# EAGLE board MCS (EAGLE 6.5.0)
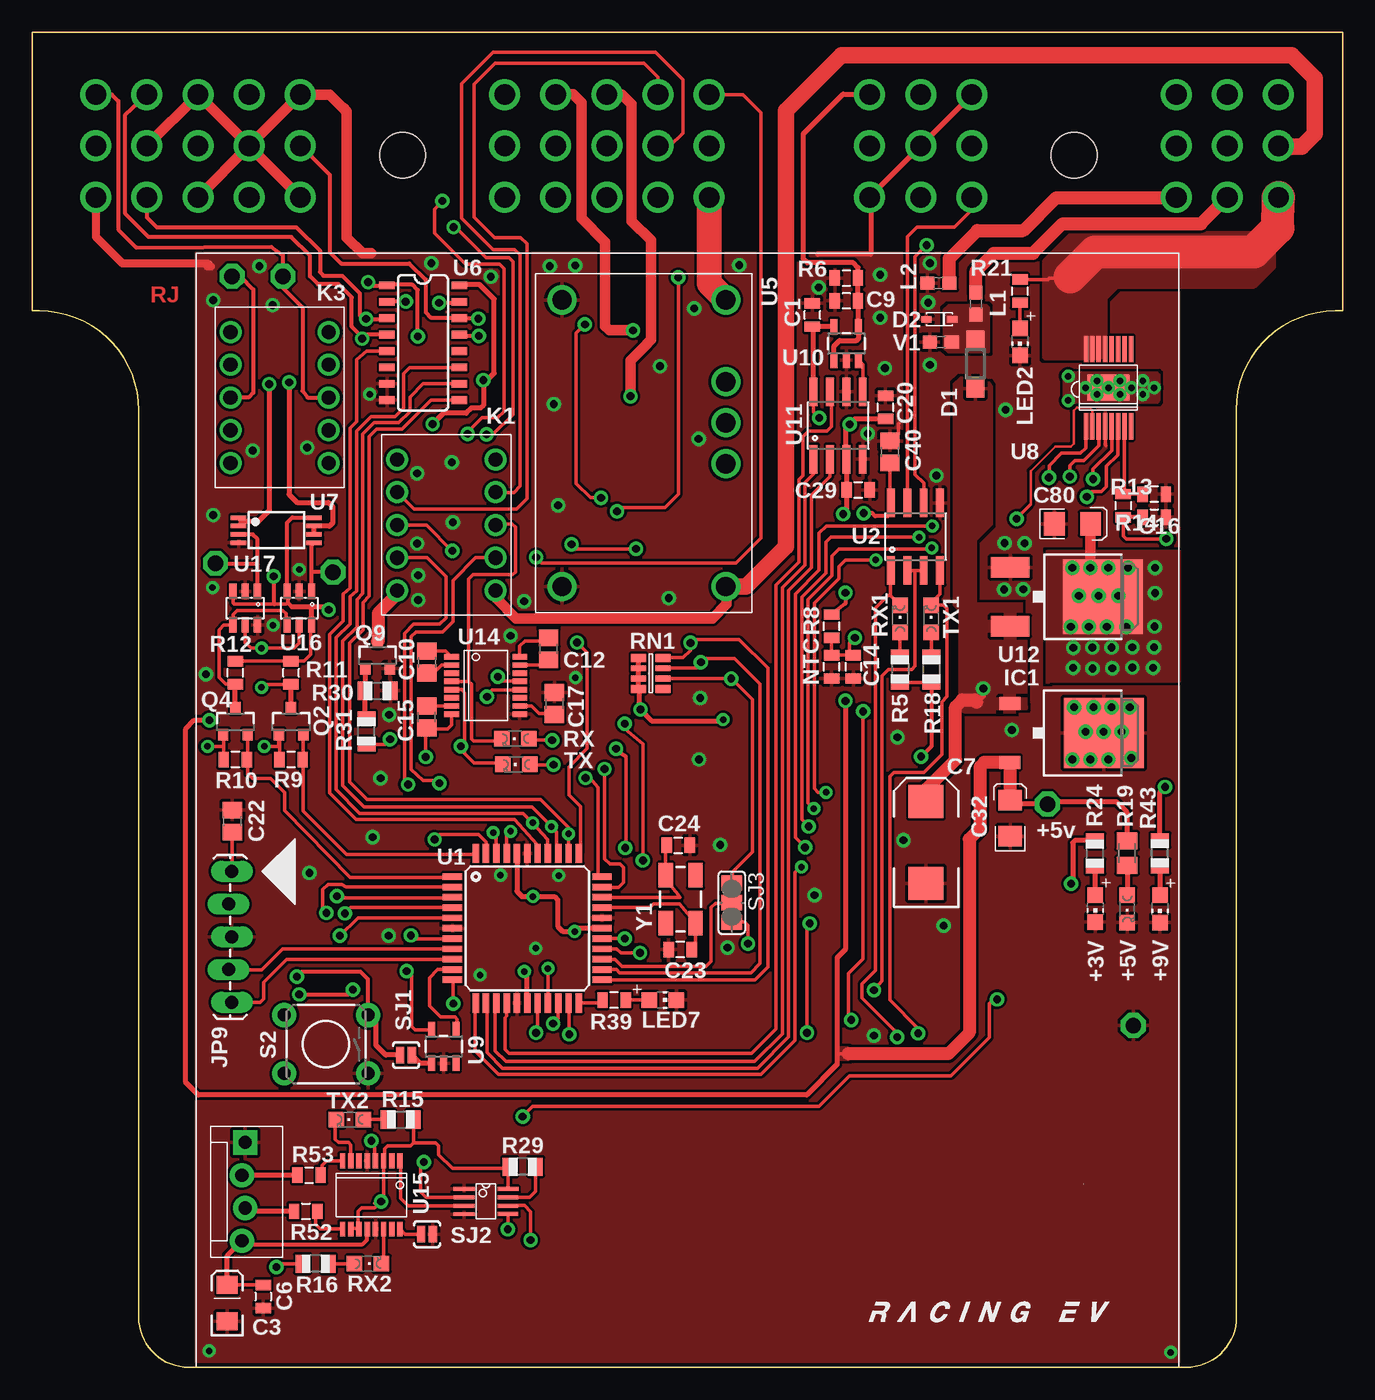
[diagram p3: board, top side]
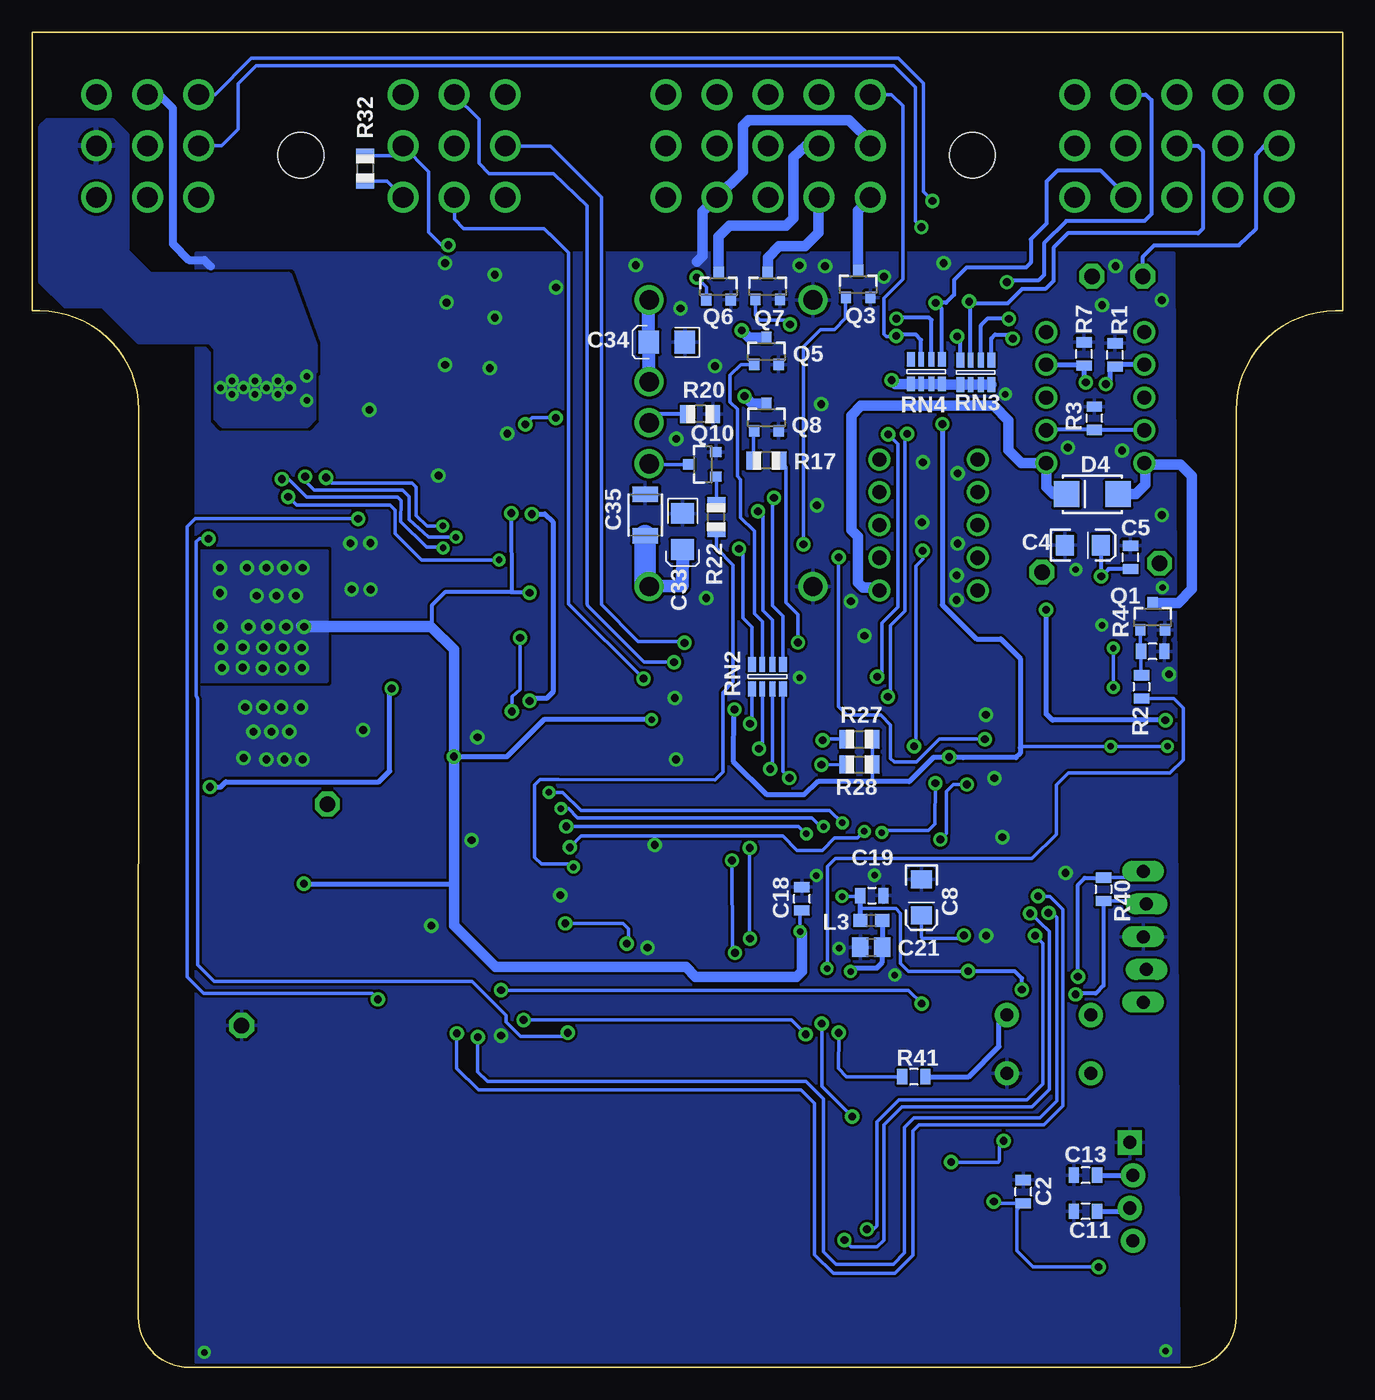
[diagram p4: board, bottom side, seen from below]

Size 101.6 x 103.51 mm. Coordinates in mm from the lower left corner, seen from the top.
Copper layers (1*16): Top 0.035mm / dielectric 1.5mm / Bottom 0.035mm
Design rules "SparkFun": minimum track width 8mil, minimum drill 20mil, track to track 8mil, track to pad 8mil, pad to pad 8mil, via to via 8mil, smd to smd 8mil, copper to edge 10mil, drill to drill 8mil, minimum pad ring 12mil, minimum via ring 10mil, stop-mask expansion 4mil, vias tented up to drill 25mil, thermal gap 10mil

## Footprints (pad centres in the part's own frame; a part is rotated, then mirrored left to right if it is on the bottom)
CHIP-LED0805 = smd 1.2 x 1.2: A 0,-1.05; C 0,1.05
CHIPLED_0805 = smd 1.2 x 1.2: A 0,-1.05; C 0,1.05
0805 = smd 0.8 x 1.2: 1 -0.9,0; 2 0.9,0
EIA3216 = smd 1.4 x 1.6: A 1.4,0; C -1.4,0
EIA7343 = smd 2.55 x 2.7: A 3.17,0; C -3.17,0
C0805 = smd 1.3 x 1.5: 1 -0.85,0; 2 0.85,0
POLC1206 = smd 1.6 x 1.8: 1 -1.4,0; 2 1.4,0
1210 = smd 1.2 x 2: 1 -1.6,0; 2 1.6,0
581-01-48-009 = drill 1.6: 1 -45.872,4.699; 2 -45.872,0.711; 3 -45.872,-3.277; 4 -41.91,4.699; 5 -41.91,0.711; 6 -41.91,-3.277; 7 -37.948,4.699; 8 -37.948,0.711; 9 -37.948,-3.277; 10 -33.985,4.699; 11 -33.985,0.711; 12 -33.985,-3.277; 13 -30.023,4.699; 14 -30.023,0.711; 15 -30.023,-3.277; 16 -14.173,4.699; 17 -14.173,0.711; 18 -14.173,-3.277; 19 -10.211,4.699; 20 -10.211,0.711; 21 -10.211,-3.277; 22 -6.248,4.699; 23 -6.248,0.711; 24 -6.248,-3.277; 25 -2.286,4.699; 26 -2.286,0.711; 27 -2.286,-3.277; 28 1.676,4.699; 29 1.676,0.711; 30 1.676,-3.277; 31 14.122,4.699; 32 14.122,0.711; 33 14.122,-3.277; 34 18.085,4.699; 35 18.085,0.711; 36 18.085,-3.277; 37 22.047,4.699; 38 22.047,0.711; 39 22.047,-3.277; 40 37.897,4.699; 41 37.897,0.711; 42 37.897,-3.277; 43 41.859,4.699; 44 41.859,0.711; 45 41.859,-3.277; 46 45.822,4.699; 47 45.822,0.711; 48 45.822,-3.277 | hole 3.556: -22.098,0; 29.972,0
SOD123 = smd 1.4 x 1.4: A 1.9,0; C -1.9,0
SOD-523F = smd 0.8 x 0.5: A -1,0; C 1,0
SMA-DIODE_ALT = smd 2 x 2: A -2,0; C 2,0
TO252 = smd 1 x 1.6: 1 -2.28,-4.8; 2 2.28,-4.8 | smd 5.4 x 6.2: 3 0,2.5
1X05_LOCK_LONGPADS = drill 1.016 long: 1 0,0; 2 2.54,-0.254; 3 5.08,0; 4 7.62,-0.254; 5 10.16,0
MOLEX-1X4_LOCK = drill 1.016 pad 1.88 square: 1 0,0.127 | drill 1.016 pad 1.88: 2 2.54,-0.127; 3 5.08,0.127; 4 7.62,-0.127
TQ2-2M-24V = drill 1.1: 1 -5.08,-3.81; 2 -2.54,-3.81; 3 0,-3.81; 4 2.54,-3.81; 5 5.08,-3.81; 6 5.08,3.81; 7 2.54,3.81; 8 0,3.81; 9 -2.54,3.81; 10 -5.08,3.81
0603 = smd 1.1 x 1: 1 -0.85,0; 2 0.85,0
SOT23-3 = smd 0.8 x 0.9: 1 -0.95,-1; 2 0.95,-1; 3 0,1.1
R0805 = smd 1.1 x 1.4: 1 -1,0; 2 1,0
M0805 = smd 1.3 x 1.6: 1 -0.95,0; 2 0.95,0
CRA06S = smd 0.63 x 1.15: 1 -1.2,-1; 4 1.2,-1; 5 1.2,0.9; 8 -1.2,0.9 | smd 0.44 x 1.15: 2 -0.4,-1; 3 0.4,-1; 6 0.4,0.9; 7 -0.4,0.9
TACTILE-PTH = drill 1.016 pad 1.88: 1 -3.251,2.261; 2 3.251,2.261; 3 -3.251,-2.261; 4 3.251,-2.261
SJ_2S-NO = smd 0.635 x 1.27: 1 -0.45,0; 2 0.45,0
PAD-JUMPER-2-NO_YES_SILK = smd 0.635 x 1.27: 1 -0.45,0; 2 0.45,0
PAD-JUMPER-3-NO_YES_SILK_FULL_BOX = smd 1.168 x 1.6: 1 -1.524,0; 2 0,0; 3 1.524,0
4952 = drill 1.2 pad 1.93 octagon: P$1 0,0
TQFP-44 = smd 1.5 x 0.5: 1 -5.8,4; 2 -5.8,3.2; 3 -5.8,2.4; 4 -5.8,1.6; 5 -5.8,0.8; 6 -5.8,0; 7 -5.8,-0.8; 8 -5.8,-1.6; 9 -5.8,-2.4; 10 -5.8,-3.2; 11 -5.8,-4; 23 5.8,-4; 24 5.8,-3.2; 25 5.8,-2.4; 26 5.8,-1.6; 27 5.8,-0.8; 28 5.8,0; 29 5.8,0.8; 30 5.8,1.6; 31 5.8,2.4; 32 5.8,3.2; 33 5.8,4 | smd 0.5 x 1.5: 12 -4,-5.8; 13 -3.2,-5.8; 14 -2.4,-5.8; 15 -1.6,-5.8; 16 -0.8,-5.8; 17 0,-5.8; 18 0.8,-5.8; 19 1.6,-5.8; 20 2.4,-5.8; 21 3.2,-5.8; 22 4,-5.8; 34 4,5.8; 35 3.2,5.8; 36 2.4,5.8; 37 1.6,5.8; 38 0.8,5.8; 39 0,5.8; 40 -0.8,5.8; 41 -1.6,5.8; 42 -2.4,5.8; 43 -3.2,5.8; 44 -4,5.8
SO-8 = smd 0.61 x 2.21: 1 -1.905,-2.616; 2 -0.635,-2.616; 3 0.635,-2.616; 4 1.905,-2.616; 5 1.905,2.616; 6 0.635,2.616; 7 -0.635,2.616; 8 -1.905,2.616
VFSOP-8 = smd 0.3 x 1.6: 1 -0.98,-1.7; 2 -0.33,-1.7; 3 0.33,-1.7; 4 0.98,-1.7; 5 0.97,1.69; 6 0.325,1.7; 7 -0.33,1.7; 8 -0.98,1.71
PTN78060HAH = drill 1.5: 1 2.032,14.732; 2 2.032,2.032; 3 11.557,2.032; 4 14.732,2.032; 5 17.907,2.032; 6 24.257,2.032; 7 24.257,14.732
SO016 = smd 0.6 x 1.2: 1 -4.445,-2.8; 2 -3.175,-2.8; 3 -1.905,-2.8; 4 -0.635,-2.8; 5 0.635,-2.8; 6 1.905,-2.8; 7 3.175,-2.8; 8 4.445,-2.8; 9 4.445,2.8; 10 3.175,2.8; 11 1.905,2.8; 12 0.635,2.8; 13 -0.635,2.8; 14 -1.905,2.8; 15 -3.175,2.8; 16 -4.445,2.8
TSSOP-08 = smd 1.2 x 0.35: 1 -2.925,0.975; 2 -2.925,0.325; 3 -2.925,-0.325; 4 -2.925,-0.975; 5 2.925,-0.975; 6 2.925,-0.325; 7 2.925,0.325; 8 2.925,0.975
SSO-16-POWER = smd 2.032 x 0.35: 1 -3,1.75; 2 -3,1.25; 3 -3,0.75; 4 -3,0.25; 5 -3,-0.25; 6 -3,-0.75; 7 -3,-1.25; 8 -3,-1.75; 9 3,-1.75; 10 3,-1.25; 11 3,-0.75; 12 3,-0.25; 13 3,0.25; 14 3,0.75; 15 3,1.25; 16 3,1.75 | smd 2 x 3.25: EP 0,0
SOT23-5L = smd 0.55 x 1.2: 1 -0.95,-1.3; 2 0,-1.3; 3 0.95,-1.3; 4 0.95,1.3; 5 -0.95,1.3
SOT23-5 = smd 0.55 x 1.2: 1 -0.95,-1.3; 2 0,-1.3; 3 0.95,-1.3; 4 0.95,1.3; 5 -0.95,1.3
SO08 = smd 0.61 x 2.21: 1 -1.905,-2.616; 2 -0.635,-2.616; 3 0.635,-2.616; 4 1.905,-2.616; 5 1.905,2.616; 6 0.635,2.616; 7 -0.635,2.616; 8 -1.905,2.616
V-REG_DPACK = smd 1.6 x 3: 1 -2.28,-4.8; 3 2.28,-4.8 | smd 5.8 x 6.2: 4 0,2.38
SSOP-16 = smd 0.419 x 1.143: 1 -2.223,-2.642; 2 -1.587,-2.642; 3 -0.953,-2.642; 4 -0.318,-2.642; 5 0.318,-2.642; 6 0.953,-2.642; 7 1.587,-2.642; 8 2.223,-2.642; 9 2.223,2.642; 10 1.587,2.642; 11 0.953,2.642; 12 0.318,2.642; 13 -0.318,2.642; 14 -0.953,2.642; 15 -1.587,2.642; 16 -2.223,2.642
SOT23-6 = smd 0.55 x 1.2: 1 -0.95,-1.3; 2 0,-1.3; 3 0.95,-1.3; 4 0.95,1.3; 5 0,1.3; 6 -0.95,1.3
CRYSTAL-SMD-5X3 = smd 1.9 x 1.1: 1 -1.85,-1.15; 2 1.85,-1.15; 3 1.85,1.15; 4 -1.85,1.15

## Placement (x,y rotation side)
+3V  [CHIP-LED0805]  82.42,35.56 180 top
+5V  Green  [CHIPLED_0805]  84.89,35.53 180 top
+9V  [CHIP-LED0805]  87.43,35.53 180 top
C1  0.1uF  [0805]  60.48,81.58 90 top
C2  0.1uf  [0805]  24.76,13.61 90 bottom
C3  4.7uF  [EIA3216]  15.11,4.98 90 top
C4  10uF  [EIA3216]  20.14,63.73 0 bottom
C5  0.1uF  [0805]  16.46,62.79 90 bottom
C6  0.1uf  [0805]  17.91,5.49 270 top
C7  100uF  [EIA7343]  69.29,40.69 90 top
C8  10uF  [EIA3216]  32.66,36.42 270 bottom
C9  10pF  [0805]  63.12,82.68 180 top
C10  .1uF  [C0805]  30.61,54.69 270 top
C11  47pf  [0805]  19.94,12.09 180 bottom
C12  .1uF  [C0805]  40.03,55.7 270 top
C13  47pf  [0805]  19.94,14.88 180 bottom
C14  0.1uF  [0805]  63.65,54.31 270 top
C15  .1uF  [C0805]  30.58,50.42 270 top
C16  10pF  [0805]  86.99,65.91 0 top
C17  .1uF  [C0805]  40.49,51.46 270 top
C18  0.1uF  [0805]  41.94,36.32 90 bottom
C19  0.1uF  [0805]  36.5,36.58 0 bottom
C20  0.1uF  [0805]  66.17,74.42 90 top
C21  100n  [C0805]  36.55,32.56 180 bottom
C22  10n  [C0805]  15.52,42.34 90 top
C23  12pF  [0805]  50.24,32.39 180 top
C24  12pF  [0805]  50.09,40.46 0 top
C29  0.1uF  [0805]  64.03,68.02 0 top
C32  10uF  [POLC1206]  75.82,42.57 270 top
C33  10uF  [POLC1206]  51.18,64.8 90 bottom
C34  10uF  [POLC1206]  52.4,79.48 0 bottom
C35  1uf  [1210]  54.08,66.07 90 bottom
C40  .1uF  [C0805]  66.5,70.97 90 top
C80  10uF  [POLC1206]  80.65,65.39 180 top
CASE2  581-01-48-009  [581-01-48-009]  50.8,93.98 0 top
D1  1N4001  [SOD123]  73.13,77.78 90 top
D2  MM5Z30  [SOD-523F]  70.33,81.25 0 top
D4  [SMA-DIODE_ALT]  19.41,67.69 180 bottom
IC1  7805DT  [TO252]  80.59,49.17 270 top
JP9  ICSP  [1X05_LOCK_LONGPADS]  15.47,38.46 270 top
JP13  [MOLEX-1X4_LOCK]  16.38,17.42 270 top
K1  TQ2-2M-24V  [TQ2-2M-24V]  32.11,65.3 90 top
K3  TQ2-2M-24V  [TQ2-2M-24V]  19.18,75.18 90 top
L1  FB  [0603]  73.17,82.47 270 top
L2  FB  [0603]  70.26,84.04 180 top
L3  FB  [0603]  36.55,34.65 180 bottom
LED2  [CHIP-LED0805]  76.58,79.5 180 top
LED7  [CHIP-LED0805]  48.89,28.47 270 top
NTC  [0805]  61.98,54.31 90 top
Q1  BSS123  [SOT23-3]  14.73,58.17 0 bottom
Q2  BSS123  [SOT23-3]  20.07,50.04 0 top
Q3  BSS123  [SOT23-3]  37.57,83.95 0 bottom
Q4  BSS123  [SOT23-3]  15.75,50.04 0 top
Q5  BSS123  [SOT23-3]  44.68,78.74 0 bottom
Q6  BSS123  [SOT23-3]  48.39,83.77 0 bottom
Q7  BSS123  [SOT23-3]  44.58,83.79 0 bottom
Q8  BSS123  [SOT23-3]  44.68,73.61 0 bottom
Q9  BSS123  [SOT23-3]  26.77,55.17 0 top
Q10  BSS123  [SOT23-3]  49.61,70 90 bottom
R1  10k  [0805]  17.65,78.49 90 bottom
R2  1k  [0805]  15.6,52.76 270 bottom
R3  100  [0805]  19.25,73.58 90 bottom
R4  100k  [0805]  14.73,55.5 180 bottom
R5  1K  [R0805]  67.28,54.1 270 top
R6  10k  [0805]  63.12,84.45 0 top
R7  10k  [0805]  20.07,78.56 90 bottom
R8  10k  [0805]  61.98,57.45 90 top
R9  2k  [0805]  20.07,47.12 180 top
R10  2k  [0805]  15.75,47.12 180 top
R11  10k  [0805]  20.07,53.85 90 top
R12  10k  [0805]  15.75,53.85 90 top
R13  10k  [0805]  86.99,67.69 180 top
R14  10k  [0805]  84.58,66.8 270 top
R15  1K  [R0805]  28.57,19.2 0 top
R16  1k  [R0805]  21.97,8.03 180 top
R17  1K  [R0805]  44.68,70.31 180 bottom
R18  1k  [R0805]  69.7,54.1 270 top
R19  1K  [M0805]  84.89,39.85 270 top
R20  383k  [R0805]  49.81,73.91 180 bottom
R21  3.3k  [0805]  76.58,83.44 90 top
R22  1K  [R0805]  48.56,65.91 90 bottom
R24  499  [R0805]  82.4,39.83 90 top
R27  1K  [R0805]  37.46,48.69 0 bottom
R28  1k  [R0805]  37.46,46.74 0 bottom
R29  1K  [R0805]  38.02,15.54 180 top
R30  10K  [R0805]  26.77,52.45 0 top
R31  1K  [R0805]  25.91,49.3 90 top
R32  120  [R0805]  75.79,92.94 270 bottom
R39  499  [0805]  45.11,28.47 180 top
R40  10k  [0805]  18.54,37.06 270 bottom
R41  499  [0805]  33.25,22.53 180 bottom
R43  1.2k  [R0805]  87.43,39.85 90 top
R52  27  [0805]  21.21,12.09 0 top
R53  27  [0805]  21.46,14.88 0 top
RN1  RN-4  [CRA06S]  48.01,53.8 270 top
RN2  RN-4  [CRA06S]  44.6,53.59 0 bottom
RN3  RN-4  [CRA06S]  28.45,77.09 180 bottom
RN4  RN-4  [CRA06S]  32.28,77.14 180 bottom
RX  [CHIPLED_0805]  37.46,48.74 90 top
RX1  RED  [CHIPLED_0805]  67.28,58.04 0 top
RX2  [CHIPLED_0805]  26.03,8.03 270 top
S2  ts  [TACTILE-PTH]  22.78,25.04 180 top
SJ1  SJ-NO  [SJ_2S-NO]  28.98,24.21 180 top
SJ2  [PAD-JUMPER-2-NO_YES_SILK]  30.61,10.31 180 top
SJ3  [PAD-JUMPER-3-NO_YES_SILK_FULL_BOX]  54.23,36.02 270 top
TP1  TESTPOINT  [4952]  85.37,26.49 0 top
TP2  TESTPOINT  [4952]  78.71,43.66 0 top
TP3  TESTPOINT  [4952]  23.32,61.65 180 top
TP4  TESTPOINT  [4952]  15.49,84.58 0 top
TP5  TESTPOINT  [4952]  19.43,84.58 0 top
TP8  TESTPOINT  [4952]  14.2,62.33 180 top
TX  [CHIPLED_0805]  37.54,46.74 90 top
TX1  GREEN  [CHIPLED_0805]  69.7,58.04 0 top
TX2  [CHIPLED_0805]  24.64,19.2 90 top
U1  DSPIC33FJ128GP804  [TQFP-44]  38.38,34.04 0 top
U2  SN75HVD08DR  [SO-8]  68.48,64.39 0 top
U4  SN74LVC2G241DCTR  [VFSOP-8]  35.18,12.85 270 top
U5  PTN78060HAH  [PTN78060HAH]  55.8,58.5 90 top
U6  SN74HC251_SMD  [SO016]  30.3,79.43 270 top
U7  LM158  [TSSOP-08]  18.92,64.9 0 top
U8  VND7040AJTR-E  [SSO-16-POWER]  83.44,75.95 90 top
U9  MAX823  [SOT23-5L]  31.9,24.87 0 top
U10  OPA344  [SOT23-5]  63.12,79.38 0 top
U11  X9015_DIGI_POTS  [SO08]  62.48,73.03 0 top
U12  NCP1117DT33T5G  [V-REG_DPACK]  80.62,59.74 270 top
U14  ADM3101E  [SSOP-16]  35.15,52.86 270 top
U15  FT230X  [SSOP-16]  26.29,13.36 180 top
U16  MCP4725  [SOT23-6]  20.7,58.85 180 top
U17  MCP4725  [SOT23-6]  16.51,58.85 180 top
U$1  LOGOM  [L-M]  57.35,1.5 0 top
U$2  INDPK1  [PICKIT-PIN-1]  17.83,38.43 270 top
V1  13Vdc  [0603]  70.44,79.47 0 top
Y1  12Mhz  [CRYSTAL-SMD-5X3]  50.27,36.3 90 top

## Tracks (layer width: path | path; a pad name or v marks a point on that pad's centre or on a via)
3V  (via drill 0.6)
  Top 0.254: 25.27,10.78 25.27,12.09 25.53,12.34 26.54,12.34 v27.05,12.85 26.91,12.71 26.54,12.71 27.24,13.41 U15.3 27.31,16.07 27.31,16.92 27.56,17.17 29.34,17.17 29.58,17.41 | 25.27,10.78 U15.11 | 25.27,10.78 24.77,10.78 U15.10 | R16.2 19.18,8.03 v18.92,7.77 | R15.2 29.58,17.41 | U4.8 36.89,15.41 | 36.89,15.41 R29.2 | 36.89,15.41 32.57,15.41 31.5,16.48 31.5,17.17 31.27,17.4 29.58,17.4 29.58,17.41
  Bottom 0.254: v27.05,12.85 26.91,12.71 C2.1 25.27,12.21 25.27,9.04 24,7.77 v18.92,7.77
12V-EN  (via drill 0.5)
  Top 0.254: U1.12 34.34,28.2 34.34,24.51 36.14,22.71 56.49,22.71 59.13,25.35 59.13,38.38 59.54,38.79 v59.64,38.79
  Bottom 0.254: R22.1 48.56,63.5 47.27,62.2 47.27,53.11 48.06,52.32 48.06,46.15 48.67,45.54 60.81,45.57 62.23,45.57 62.64,45.16 62.64,39.52 62.13,39.01 59.87,39.01 v59.64,38.79
!CS
  Top 0.254: U1.15 36.78,27.23 36.65,27.1 36.65,24.64 36.96,24.33 55.75,24.33 57.66,26.24 57.66,60.65 59.44,62.43 59.44,68.81 59.77,69.14 59.77,72.16 60.2,72.59 61.62,72.59 61.95,72.92 61.95,75.54 U11.7
!RST  (via drill 0.6)
  Top 0.203: U8.2 82.19,74.19 81.99,74.4 80.98,74.4 80.75,74.17 80.75,71.63 80.52,71.4 79.32,71.4 77.42,69.49 77.42,66.9 77.34,66.83
  Top 0.254: U1.20 40.78,27.04 v40.39,26.64 | v38.02,19.43 38.02,19.46 38.79,20.22 60.99,20.22 63.37,22.61 71.22,22.61 74.19,25.58 74.19,28.19 74.52,28.52 v74.8,28.52 | v76.33,65.79 76.3,65.79 77.34,66.83 | U8.2
  Bottom 0.254: v40.39,26.64 40.39,21.79 v38.02,19.43 | v76.33,65.79 88.98,65.79 89.59,65.18 89.59,30.25 88.32,28.98 75.26,28.98 v74.8,28.52
+
  Top 1.016: L1.1 73.17,84.99 74.55,86.36 77.6,86.36 79.88,88.65 90.6,88.65 CASE2.45
+3V3  (via drill 0.5, 0.6)
  Top 0.254: U14.8 32.51,49.81 32.21,49.5 30.65,49.5 C15.2 30.51,49.49 v30.51,47.32 | R18.2 R5.2 | Q4.1 14.85,48.99 R10.2 14.85,48.02 14.73,48.13 v13.59,48.13 | R9.2 19.17,48.99 Q2.1 19.12,48.2 19.05,48.13 v17.98,48.13 | C40.1 66.5,67.08 U2.8 | U9.5 29.69,26.17 29.41,26.44 29.41,30.33 v29.03,30.71
  Top 0.305: U2.8 66.57,66.24 66.32,65.99 65.35,65.99 65.13,66.22 v64.47,66.22 | v63.04,60.05 63.04,59.19 R8.2 | R18.2 69.7,48.13 v68.91,47.35 | v20.7,28.9 24.49,28.9 v24.87,29.29
  Top 0.406: v34.98,76.53 35,76.53 | U6.16 33.18,83.95 34.67,83.95 35.81,82.83 35.81,77.06 35.28,76.53 35,76.53 | 35,76.53 34.98,76.5 34.98,74.57 34.77,74.37 34.06,74.37 33.66,73.96 31.88,73.96 v31.04,73.13 | RN1.1 RN1.2 RN1.3 RN1.4 47.09,52.51 47.09,51.05 v47.16,50.99 48.03,50.11 53.47,50.11 v53.57,50.22 | U1.28 42.32,34.04 v42.06,33.78 42.04,33.81 41.12,33.81 40.74,34.19 40.74,36.25 40.49,36.5 v38.81,36.5 37.97,36.5 37.58,36.89 U1.40 | R24.2 80.83,40.83 80.67,40.67 80.67,37.62 v80.54,37.49
  Top 0.813: C80.1 82.05,63.33 | 82.05,63.33 82.04,63.32 | 82.05,63.33 v82.05,61.98 v82.04,61.98
  Bottom 0.254: v42.06,33.78 42.06,35.29 C18.1 | R27.2 R28.2 36.47,45.56 36.32,45.41 | v13.59,48.13 v17.98,48.13 24.89,48.13 24.99,48.03 | 37.4,34.42 L3.2 | 29.46,47.29 30.4,47.29 v30.51,47.32 | R40.2 15.46,36.16 JP9.2 | v29.03,30.71 33.68,30.71 34.29,31.32 34.29,35.18 34.65,35.56 37.4,35.56 | v38.81,36.5 37.48,36.5 C19.1
  Bottom 0.305: v64.47,66.22 64.44,60.1 | 64.44,60.1 63.09,60.1 v63.04,60.05 | 64.44,60.1 69.6,60.1 70.64,59.05 70.64,57.43 70.66,57.4 | R40.2 18.54,29.59 19.15,28.98 20.4,28.98 v20.7,28.9 | v24.87,29.29 24.87,30.15 25.43,30.71 v29.03,30.71
  Bottom 0.406: v31.04,73.13 31.04,59.11 28.4,56.46 26.52,56.46 24.99,54.94 24.99,48.03 24.99,47.6 25.32,47.27 29.44,47.27 29.46,47.29 31.72,47.29 33.6,45.41 36.32,45.41 40.67,45.41 41.78,44.37 44.63,44.37 47.22,46.94 47.19,50.95 v47.16,50.99 | 37.4,34.42 37.4,35.56 C19.1 | v53.57,50.22 61.93,50.22 64.82,47.32 68.88,47.32 v68.91,47.35 | v80.54,37.49 69.19,37.49 68.91,37.77
  Bottom 0.813: RN3.8 RN3.7 RN3.6 RN3.5 31.03,76.19 RN4.8 RN4.7 RN4.6 34.69,76.24 v34.98,76.53 | v80.52,57.4 70.66,57.4 68.91,55.65 v68.91,47.35 68.91,37.77 68.91,34.26 65.68,31.04 50.93,31.04 50.17,30.28 42.37,30.28 41.94,30.71 41.94,33.65 v42.06,33.78 | 80.75,57.45 70.89,57.45
  other vias: 80.64,61.98 83.44,61.98 84.96,61.98 81.91,57.4 83.31,57.4 84.84,57.4 81.15,59.82 82.68,59.82 84.2,59.82 85.29,55.83 80.72,55.78 80.7,54.23 82.19,55.8 82.22,54.18 83.69,55.8 83.74,54.2 85.29,54.25 87.05,61.98 87.05,60.02 87.02,57.43 86.97,55.83 86.89,54.23
  pour Top (no thermals): 78.74,63.25 88.9,63.25 88.9,53.21 78.87,53.21 78.74,53.09
  pour Bottom: 78.74,63.25 88.9,63.25 88.9,53.21 78.74,53.21
+5V  (via drill 0.6)
  Top 0.254: R12.2 R11.2 21.09,54.75 21.59,55.24 21.59,57.49 | 19.81,60.09 U16.3 | U17.3 15.56,59.27 15.67,59.16 18.77,59.16 19.69,59.16 19.81,59.28 | U11.8 60.58,74.04 v61.01,73.61 | 63.09,70.43 U11.3 | 63.25,24.31 62.48,24.31 62.41,24.23
  Top 0.305: U16.3 19.75,65.47 20.17,65.89 21.83,65.89 U7.8 | 21.62,57.59 U16.6 | 19.81,60.09 19.81,59.28 20.12,58.98 | v18.72,61.32 18.72,59.21 18.77,59.16
  Top 0.406: U16.3 19.69,60.15 | 21.59,57.49 U16.6 21.65,58.94 | U10.5 60.49,80.67 C1.1 60.58,80.58 U11.8 | 20.12,58.98 21.62,58.98 21.65,58.94 | U11.3 63.12,68.04 C29.1 63.13,66.38 v62.87,66.14 | 63.09,70.43 63.09,72.82 v63.37,73.1 63.79,73.52 C20.1 | v63.04,51.66 63.04,32.38 62.41,31.75 62.41,24.23 62.41,23.47 60.05,21.11 12.88,21.11 11.91,22.07 11.91,49.5 12.57,50.16 v13.74,50.16 | v22.99,58.72 22.96,58.72 22.76,58.93 21.67,58.93 21.65,58.94 | R19.1 84.89,43 84.05,43.84 78.89,43.84 TP2.P$1 76.13,43.66 C32.1